# EasyEDA Pro project hardware.eprj, schematic Schematic3
Create Date: 2022-11-23; Page Name: P1; Project Name: SCH_tc264_2022-07-02; Schematic Name: Schematic3; Update Date: 2022-11-23; Company: 嘉立创EDA; Page Size: A2; Version: V1.0
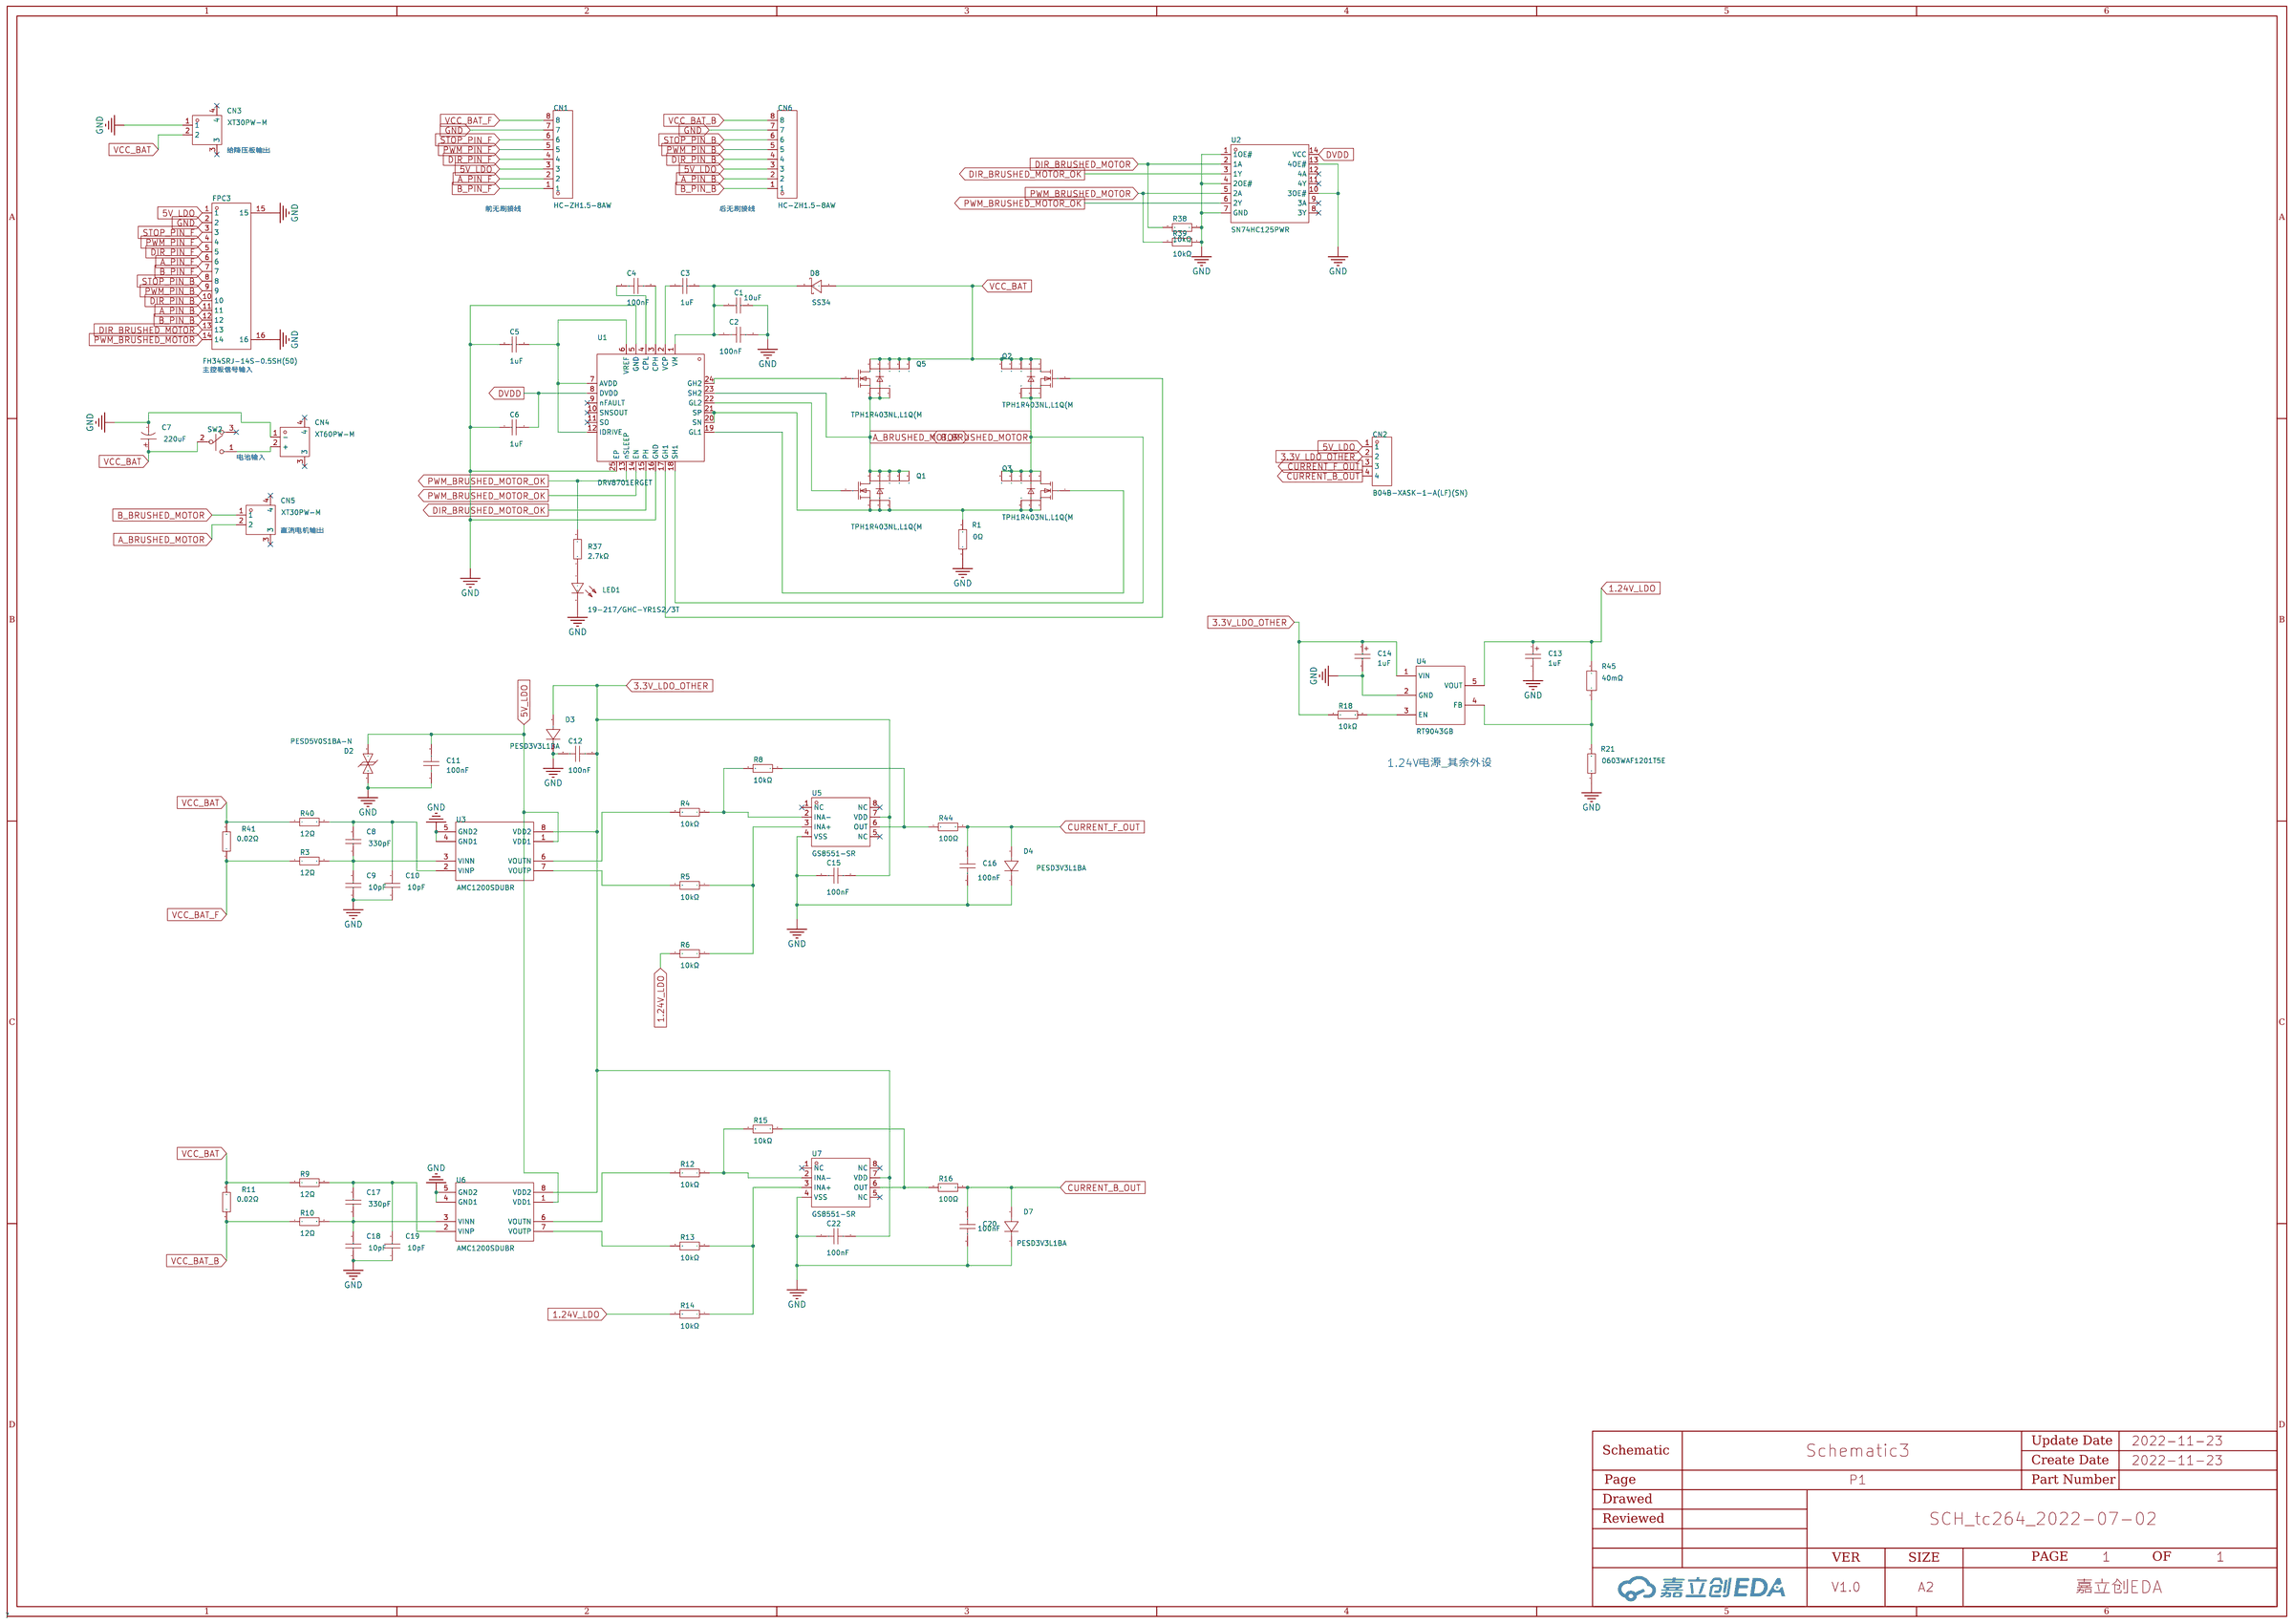
[diagram p3: schematic sheet]

## Parts
C1  10uF  [C1206]
C2  100nF  [C0603]
C3  1uF  [C0603]
C4  100nF  [C0603]
C5  1uF  [C0603]
C6  1uF  [C0603]
C7  220uF  [CAP-TH_BD10.0-P5.00-D1.0-FD]
C8  330pF  [C0603]
C9  10pF  [C0402]
C10  10pF  [C0402]
C11  100nF  [C0603]
C12  100nF  [C0603]
C13  1uF  [CAP-SMD_L3.2-W1.6-RD]
C14  1uF  [CAP-SMD_L3.2-W1.6-RD]
C15  100nF  [C0603]
C16  100nF  [C0603]
C17  330pF  [C0603]
C18  10pF  [C0402]
C19  10pF  [C0402]
C20  100nF  [C0603]
C22  100nF  [C0603]
CN1  HC-ZH1.5-8AW  [CONN-TH_8P-P1.50_HCTL_HC-ZH1.5-8AW]
CN2  B04B-XASK-1-A(LF)(SN)  [CONN-TH_B04B-XASK-1-A-LF-SN]
CN3  XT30PW-M  [CONN-TH_XT30PW-M]
CN4  XT60PW-M  [CONN-TH_XT60PW-M]
CN5  XT30PW-M  [CONN-TH_XT30PW-M]
CN6  HC-ZH1.5-8AW  [CONN-TH_8P-P1.50_HCTL_HC-ZH1.5-8AW]
D2  PESD5V0S1BA-N  [SOD-323_L1.8-W1.3-LS2.5-BI]
D3  PESD3V3L1BA  [SOD-323_L1.7-W1.3-LS2.6-RD-1]
D4  PESD3V3L1BA  [SOD-323_L1.7-W1.3-LS2.6-RD-1]
D7  PESD3V3L1BA  [SOD-323_L1.7-W1.3-LS2.6-RD-1]
D8  SS34  [DO-214AC_L4.3-W2.7-LS5.3-RD]
FPC3  FH34SRJ-14S-0.5SH(50)  [FFC-SMD_14P-P0.50_FH34SRJ-14S-0.5SH]
LED1  19-217/GHC-YR1S2/3T  [LED0603-R-RD]
Q1  TPH1R403NL,L1Q(M  [DSOP-8_L5.0-W5.0-P1.27-LS6.0-BL-EP]
Q2  TPH1R403NL,L1Q(M  [DSOP-8_L5.0-W5.0-P1.27-LS6.0-BL-EP]
Q3  TPH1R403NL,L1Q(M  [DSOP-8_L5.0-W5.0-P1.27-LS6.0-BL-EP]
Q5  TPH1R403NL,L1Q(M  [DSOP-8_L5.0-W5.0-P1.27-LS6.0-BL-EP]
R1  0Ω  [R0603]
R3  12Ω  [R0402]
R4  10kΩ  [R0603]
R5  10kΩ  [R0603]
R6  10kΩ  [R0603]
R8  10kΩ  [R0603]
R9  12Ω  [R0402]
R10  12Ω  [R0402]
R11  0.02Ω  [R2512]
R12  10kΩ  [R0603]
R13  10kΩ  [R0603]
R14  10kΩ  [R0603]
R15  10kΩ  [R0603]
R16  100Ω  [R0603]
R18  10kΩ  [R0603]
R21  0603WAF1201T5E  [R0603]
R37  2.7kΩ  [R0603]
R38  10kΩ  [R0603]
R39  10kΩ  [R0603]
R40  12Ω  [R0402]
R41  0.02Ω  [R2512]
R44  100Ω  [R0603]
R45  40mΩ  [R0603]
SW2  MT-0-103-A101-M200-RS+PJ  [SW-TH_MT-0-103-A101-M200-RS]
U1  DRV8701ERGET  [VQFN-24_L4.0-W4.0-P0.50-LS4.0-BL-EP]
U2  SN74HC125PWR  [TSSOP-14_L5.0-W4.4-P0.65-LS6.5-BL]
U3  AMC1200SDUBR  [SOP-8_L9.8-W6.6-P2.54-LS10.3-BL]
U4  RT9043GB  [SOT-23-5_L3.0-W1.7-P0.95-LS2.8-BR]
U5  GS8551-SR  [SOP-8_L4.9-W3.9-P1.27-LS6.0-BL]
U6  AMC1200SDUBR  [SOP-8_L9.8-W6.6-P2.54-LS10.3-BL]
U7  GS8551-SR  [SOP-8_L4.9-W3.9-P1.27-LS6.0-BL]

## Library data of the parts
C1 = CL31A106KBHNNNE: 容值:10uF;精度:±10%;额定电压:50V;材质(温度系数):X5R;; LCSC Part Name: 10uF ±10% 50V; Supplier Part: C13585; Manufacturer: SAMSUNG(三星); Supplier Footprint: 1206; JLCPCB Part Class: Basic Part; Datasheet: https://atta.szlcsc.com/upload/public/pdf/source/20160103/1457707668742.pdf; Supplier: LCSC; Tolerance: ±10%; Voltage Rated: 50V; Temperature Coefficient: X5R
C2 C4 C11 C12 C15 C16 C20 C22 = CC0603KRX7R9BB104: 容值:100nF;精度:±10%;额定电压:50V;材质(温度系数):X7R;; LCSC Part Name: 100nF ±10% 50V; Supplier Part: C14663; Manufacturer: YAGEO(国巨); Supplier Footprint: 0603; JLCPCB Part Class: Basic Part; Datasheet: https://atta.szlcsc.com/upload/public/pdf/source/20170116/1484561234239.pdf; Supplier: LCSC; Tolerance: ±10%; Voltage Rated: 50V; Temperature Coefficient: X7R
C3 C5 C6 = CL10A105KB8NNNC: 温度系数:X5R;精度:±10%;额定电压:50V;容值:1uF;; LCSC Part Name: 1uF(105) ±10% 50V; Supplier Part: C15849; Manufacturer: SAMSUNG(三星); Supplier Footprint: 0603; JLCPCB Part Class: Basic Part; Datasheet: https://atta.szlcsc.com/upload/public/pdf/source/20160103/1457707679084.pdf; Supplier: LCSC; Temperature Coefficient: X5R; Tolerance: ±10%; Voltage Rated: 50V
C7 = KM227M050G13RR0VH2FP0: 容值:220uF;脚间距:5mm;纹波电流:-;额定电压:50V;等效串联电阻:-;精度:±20%;工作寿命:2000hrs 105;电容体直径:10mm;工作温度:-;电容体长度:13mm;; LCSC Part Name: 220uF 50V; Supplier Part: C45105; Manufacturer: CX(承兴); Supplier Footprint: 径向引线,10x13mm; JLCPCB Part Class: Extended Part; Datasheet: https://atta.szlcsc.com/upload/public/pdf/source/20151029/1457707529682.pdf; Supplier: LCSC; Lead Spacing: 5mm; Rated Voltage: 50V; Tolerance: ±20%; Lifetime @ Temp: 2000hrs 105; φD: 10mm; L: 13mm
C8 C17 = CC0603JRNPO9BN331: 容值:330pF;精度:±5%;额定电压:50V;材质(温度系数):NP0;; LCSC Part Name: 330pF ±5% 50V; Supplier Part: C62784; Manufacturer: YAGEO(国巨); Supplier Footprint: 0603; JLCPCB Part Class: Extended Part; Datasheet: https://atta.szlcsc.com/upload/public/pdf/source/20151222/1457707651299.pdf; Supplier: LCSC; Tolerance: ±5%; Voltage Rated: 50V; Temperature Coefficient: NP0
C9 C10 C18 C19 = CC0402JRNPO9BN100: 容值:10pF;精度:±5%;额定电压:50V;材质(温度系数):NP0;; LCSC Part Name: 10pF ±5% 50V; Supplier Part: C106199; Manufacturer: YAGEO(国巨); Supplier Footprint: 0402; JLCPCB Part Class: Extended Part; Datasheet: https://atta.szlcsc.com/upload/public/pdf/source/20170518/1495085708228.pdf; Supplier: LCSC; Tolerance: ±5%; Voltage Rated: 50V; Temperature Coefficient: NP0
C13 C14 = TAJA105K016RNJ: 容值:1uF;精度:±10%;额定电压:16V;等效串联电阻:-;工作温度:-55~+125;; LCSC Part Name: 1uF ±10% 16V; Supplier Part: C7174; Manufacturer: Kyocera AVX; Supplier Footprint: CASE-A_3216; JLCPCB Part Class: Extended Part; Datasheet: https://atta.szlcsc.com/upload/public/pdf/source/20160107/1457707748219.pdf; Supplier: LCSC; Tolerance: ±10%; Rated Voltage: 16V; Operating Temperature: -55~+125
CN1 CN6 = HC-ZH1.5-8AW: 参考系列:ZH;间距:1.5mm;插针结构:1x8P;排数:1;每排PIN数:8;行距:-;公母:公型插针;安装方式:弯插;额定电流:1A;工作温度范围:-25~+85;; LCSC Part Name: 8P 间距P=1.5mm; Supplier Part: C2845571; Manufacturer: HCTL(华灿天禄); Supplier Footprint: 插件,P=1.5mm; JLCPCB Part Class: Extended Part; Datasheet: https://atta.szlcsc.com/upload/public/pdf/source/20211122/624702E7E83328BF37B6C704FA01E49F.pdf; Supplier: LCSC; Reference Series: ZH; Pitch: 1.5mm; Pins Structure: 1x8P; Number of Rows: 1; Number of PINs Per Row: 8; Gender: 公型插针; Mounting Style: 弯插; Current Rating (Max): 1A; Operating Temperature Range: -25~+85
CN2 = B04B-XASK-1-A(LF)(SN): 参考系列:XA;间距:2.5mm;插针结构:1x4P;排数:1;每排PIN数:4;行距:-;公母:公型插针;安装方式:直插;额定电流:3A;工作温度范围:-25~+85;; LCSC Part Name: 4P 脚距2.5mm; Supplier Part: C491709; Manufacturer: JST; Supplier Footprint: 插件,P=2.5mm; JLCPCB Part Class: Extended Part; Datasheet: https://atta.szlcsc.com/upload/public/pdf/source/20200416/C514162_2DCD7D1CD2019D14145B8FEA1B6236C2.pdf; Supplier: LCSC; Reference Series: XA; Pitch: 2.5mm; Pins Structure: 1x4P; Number of Rows: 1; Number of PINs Per Row: 4; Gender: 公型插针; Mounting Style: 直插; Current Rating (Max): 3A; Operating Temperature Range: -25~+85
CN3 CN5 = XT30PW-M: Socket,DCsupply,XT30,male,PIN:2; LCSC Part Name: XT30PW-M公头; Supplier Part: C431092; Manufacturer: AMASS(艾迈斯); Supplier Footprint: Through Hole; JLCPCB Part Class: Extended Part; Datasheet: https://atta.szlcsc.com/upload/public/pdf/source/20220222/6A9F22F7850E25B33E1BE430ADF8560B.pdf; Supplier: LCSC
CN4 = XT60PW-M: 模型锂电连接器; LCSC Part Name: XT60PW 公头 板插卧式; Supplier Part: C98732; Manufacturer: AMASS(艾迈斯); Supplier Footprint: Through Hole; JLCPCB Part Class: Extended Part; Datasheet: https://atta.szlcsc.com/upload/public/pdf/source/20180125/C98732_15168617837851301983.pdf; Supplier: LCSC
D2 = PESD5V0S1BA-N: 极性:Bidirectional;反向关断电压（典型值）:5V (Max);击穿电压（最小值）:6V;箝位电压:21V;峰值脉冲电流（10/1000us）:17A (8/20us);; Supplier Part: C314260; Manufacturer: BORN伯恩半导体; Supplier Footprint: SOD-323; JLCPCB Part Class: Extended Part; Datasheet: https://atta.szlcsc.com/upload/public/pdf/source/20181015/C314260_74616720B766DD44AADECF2576FF880A.pdf; Supplier: LCSC; Polarity: Bidirectional; Voltage - Reverse Standoff (Typ): 5V (Max); Voltage - Breakdown (Min): 6V; Voltage - Clamping (Max) @ Ipp: 21V; Current - Peak Pulse (10/1000μs): 17A (8/20us)
D3 D4 D7 = PESD3V3L1BA_C2939000: 反向截止电压(Vrwm)：3.3V 击穿电压(最小值)：4V 峰值脉冲电流(Ipp)@tp=8/20s：20A 最大钳位电压：10.5V; Supplier Part: C2939000; Manufacturer: KUU; Supplier Footprint: SOD-323; JLCPCB Part Class: Extended Part; Datasheet: https://atta.szlcsc.com/upload/public/pdf/source/20220104/1AF8E95A9217555EAE6BA1A0A1369AB5.pdf; Supplier: LCSC
D8 = SS34_C8678: 40V,3A,VF=0.55V 3A; Supplier Part: C8678; Manufacturer: MDD; Supplier Footprint: SMA(DO-214AC); JLCPCB Part Class: Basic Part; Datasheet: https://atta.szlcsc.com/upload/public/pdf/source/20220408/D0396E57A6E83C6AFC0ED25EC9EDE030.pdf; Supplier: LCSC
FPC3 = FH34SRJ-14S-0.5SH(50): 间距:0.5mm;触点数量:14;锁定特性:-;安装类型:卧贴;触点类型:双侧触点/上下接;; LCSC Part Name: 0.5mm P数:14 双侧触点/上下接; Supplier Part: C324724; Manufacturer: HRS(广濑); Supplier Footprint: SMD,P=0.5mm; JLCPCB Part Class: Extended Part; Datasheet: https://atta.szlcsc.com/upload/public/pdf/source/20181106/C324724_DC7CE3D3468642B05BE9C7F247386E31.pdf; Supplier: LCSC; Pitch: 0.5mm; Number of Contacts: 14; Mounting Type: 卧贴; Contact Type: 双侧触点/上下接; Height Above Board: 1mm; FFC, FCB Thickness: 0.3mm
LED1 = 19-217/GHC-YR1S2/3T: 照明颜色:翠绿;色温 - CCT（K）:-;主波长/色坐标:520~535nm;; LCSC Part Name: 翠绿LED; Supplier Part: C72043; Manufacturer: EVERLIGHT(台湾亿光); Supplier Footprint: 0603; JLCPCB Part Class: Basic Part; Datasheet: https://atta.szlcsc.com/upload/public/pdf/source/20160507/1462613613780.pdf; Supplier: LCSC; Mounting Type: 表面贴装; Illumination Color: 翠绿; Luminous Intensity (IF=20mA): 112~258mcd; Dominant Wavelength / Coordinate rank: 520~535nm
Q1-Q3 Q5 = TPH1R403NL,L1Q(M: Supplier Part: C2940403; Manufacturer: TOSHIBA(东芝); Supplier Footprint: SOP-8; Datasheet: https://atta.szlcsc.com/upload/public/pdf/source/20220830/C277A7BCA37DB7348B2C95BA2E6DA6BE.pdf; Supplier: LCSC
R1 = 0603WAF0000T5E: 温度系数:-;精度:±1%;阻值:0Ω;功率:1/10W;最大工作电压:75V;工作温度范围:-55~+155;; LCSC Part Name: 0Ω ±1%; Supplier Part: C21189; Manufacturer: UNI-ROYAL(厚声); Supplier Footprint: 0603; JLCPCB Part Class: Basic Part; Datasheet: https://atta.szlcsc.com/upload/public/pdf/source/20170920/C21189_1505887441435980537.pdf; Supplier: LCSC; Tolerance: ±1%; Power(Watts): 1/10W; Overload Voltage (Max): 75V; Operating Temperature Range: -55~+155
R3 R9 R10 R40 = AR02BTC0120: 温度系数:±25ppm/;功率:1/16W;精度:±0.1%;阻值:12Ω;工作温度范围:-55~+155;电阻类型:薄膜电阻;最大工作电压:25V;; LCSC Part Name: 12Ω ±0.1%; Supplier Part: C317902; Manufacturer: Viking(光颉); Supplier Footprint: 0402; JLCPCB Part Class: Extended Part; Datasheet: https://atta.szlcsc.com/upload/public/pdf/source/20181031/C317902_C993E8B47B3BD465DE6386902EF1EEAB.pdf; Supplier: LCSC; Temperature Coefficient: ±25ppm/; Power(Watts): 1/16W; Tolerance: ±0.1%; Operating Temperature Range: -55~+155; Type: 薄膜电阻; Overload Voltage (Max): 25V
R4-R6 R8 R12-R15 R18 R38 R39 = 0603WAF1002T5E: 电阻类型:厚膜电阻;阻值:10kΩ;精度:±1%;功率:100mW;温度系数:±100ppm/;最大工作电压:75V;工作温度范围:-55~+155;; LCSC Part Name: 10kΩ ±1% 100mW; Supplier Part: C25804; Manufacturer: UNI-ROYAL(厚声); Supplier Footprint: 0603; JLCPCB Part Class: Basic Part; Datasheet: https://atta.szlcsc.com/upload/public/pdf/source/20200306/C422600_1E6D84923E4A46A82E41ADD87F860B5C.pdf; Supplier: LCSC; Type: 厚膜电阻; Tolerance: ±1%; Power(Watts): 100mW; Temperature Coefficient: ±100ppm/; Overload Voltage (Max): 75V; Operating Temperature Range: -55~+155
R11 R41 = FMF25FPJR020-LH: 精度:±1%;阻值:0.02Ω;功率:2W;温度系数:±70ppm/;; LCSC Part Name: 0.02Ω(R020) ±1% 2W; Supplier Part: C105360; Manufacturer: PSA(信昌电陶); Supplier Footprint: 2512; JLCPCB Part Class: Extended Part; Datasheet: https://atta.szlcsc.com/upload/public/pdf/source/20170410/1491788443938.pdf; Supplier: LCSC; Tolerance: ±1%; Power(Watts): 2W; Temperature Coefficient: ±70ppm/
R16 R44 = RT0603BRD07100RL: 电阻类型:薄膜电阻;阻值:100Ω;精度:±0.1%;功率:100mW;温度系数:±25ppm/;最大工作电压:75V;工作温度范围:-55~+155;; LCSC Part Name: 100Ω ±0.1% 100mW; Supplier Part: C122970; Manufacturer: YAGEO(国巨); Supplier Footprint: 0603; JLCPCB Part Class: Extended Part; Datasheet: https://atta.szlcsc.com/upload/public/pdf/source/20170728/C122970_1501225762145848821.pdf; Supplier: LCSC; Type: 薄膜电阻; Tolerance: ±0.1%; Power(Watts): 100mW; Temperature Coefficient: ±25ppm/; Overload Voltage (Max): 75V; Operating Temperature Range: -55~+155
R21 = 0603WAF1201T5E: LCSC Part Name: 1.2KΩ(1201) ±1% 编带; Supplier Part: C22765; Manufacturer: UNI-ROYAL(厚声); Supplier Footprint: 0603; JLCPCB Part Class: Basic Part; Datasheet: https://atta.szlcsc.com/upload/public/pdf/source/20170920/C22765_1505887453653980563.pdf; Supplier: LCSC
R37 = 0603WAF2701T5E: 电阻类型:厚膜电阻;阻值:2.7kΩ;精度:±1%;功率:100mW;温度系数:±100ppm/;最大工作电压:75V;工作温度范围:-55~+155;; LCSC Part Name: 2.7kΩ ±1% 100mW; Supplier Part: C13167; Manufacturer: UNI-ROYAL(厚声); Supplier Footprint: 0603; JLCPCB Part Class: Basic Part; Datasheet: https://atta.szlcsc.com/upload/public/pdf/source/20200306/C422600_1E6D84923E4A46A82E41ADD87F860B5C.pdf; Supplier: LCSC; Type: 厚膜电阻; Tolerance: ±1%; Power(Watts): 100mW; Temperature Coefficient: ±100ppm/; Overload Voltage (Max): 75V; Operating Temperature Range: -55~+155
R45 = 0603WAJ040LT5E: 电阻类型:厚膜电阻;阻值:40mΩ;精度:±5%;功率:100mW;温度系数:±800ppm/;最大工作电压:75V;工作温度范围:-55~+155;; LCSC Part Name: 40mΩ ±5% 100mW; Supplier Part: C422883; Manufacturer: UNI-ROYAL(厚声); Supplier Footprint: 0603; JLCPCB Part Class: Extended Part; Datasheet: https://atta.szlcsc.com/upload/public/pdf/source/20200306/C422600_1E6D84923E4A46A82E41ADD87F860B5C.pdf; Supplier: LCSC; Type: 厚膜电阻; Tolerance: ±5%; Power(Watts): 100mW; Temperature Coefficient: ±800ppm/; Overload Voltage (Max): 75V; Operating Temperature Range: -55~+155
SW2 = MT-0-103-A101-M200-RS+PJ: 额定电流:5A;额定电压(AC):125V;电路结构:单刀双掷;钮柄形状:圆柱钮柄;引脚样式:焊片;安装方式:直插;工作温度:-25~+85;开关长度:13mm;开关宽度:8mm;开关高度:28.6mm;; LCSC Part Name: 小型钮子三脚三档(五件套); Supplier Part: C1788493; Manufacturer: YUEN FUNG(源丰); Supplier Footprint: 插件; JLCPCB Part Class: Extended Part; Datasheet: https://atta.szlcsc.com/upload/public/pdf/source/20201225/C1788493_608759AD4D4A20FF90A03E3E3321FD91.pdf; Supplier: LCSC; Contact Current: 5A; Voltage Rating (AC): 125V; Circuit: 单刀双掷; Actuator Type: 圆柱钮柄; Pin Style: 焊片; Mounting Style: 直插; Operating Temperature: -25~+85; Switch Length: 13mm; Switch Width: 8mm; Switch Height: 28.6mm
U1 = DRV8701ERGET: DRV8701 DRV8701 H 桥栅极驱动器; Supplier Part: C132049; Manufacturer: TI(德州仪器); Supplier Footprint: VQFN-24; JLCPCB Part Class: Extended Part; Datasheet: https://atta.szlcsc.com/upload/public/pdf/source/20170925/C132049_1506321643935990409.pdf; Supplier: LCSC
U2 = SN74HC125PWR: 逻辑电路的归属系列:74HC;逻辑类型:缓冲器，非反向;元件数:4;每元件位数:1;; Supplier Part: C132994; Manufacturer: TI(德州仪器); Supplier Footprint: TSSOP-14; JLCPCB Part Class: Extended Part; Datasheet: https://atta.szlcsc.com/upload/public/pdf/source/20170930/C132994_1506736365150997346.pdf; Supplier: LCSC; Series: 74HC; Logic Type: 缓冲器，非反向; Number of Elements: 4; Number of Bits per Element: 1; Output Type: 三态; Current - Output High, Low: 7.8mA、7.8mA; Voltage - Supply: 2V ~ 6V; Operating Temperature: -40~+85（TA）
U3 U6 = AMC1200SDUBR: AMC1200 用于并联测量的 4kV 峰值隔离放大器; Supplier Part: C39673; Manufacturer: TI(德州仪器); Supplier Footprint: SOP-8_6.6mm; JLCPCB Part Class: Extended Part; Datasheet: https://atta.szlcsc.com/upload/public/pdf/source/20141219/1457707254732.pdf; Supplier: LCSC
U4 = RT9043GB: 输出类型:可调;输出极性:正;输出通道数:1;最大输入电压:5.5V;输出电压:1.2V~5V;压差:350mV@(400mA);输出电流:400mA;电源纹波抑制比(PRSS):67dB@(1kHz),56dB@(10kHz);; LCSC Part Name: Vin=5.5V Vout=1.2V~5V 400mA 67dB@(1kHz),56dB@(10kHz); Supplier Part: C55019; Manufacturer: RICHTEK(台湾立锜); Supplier Footprint: SOT-23-5; JLCPCB Part Class: Extended Part; Datasheet: https://atta.szlcsc.com/upload/public/pdf/source/20150811/1457707342352.pdf; Supplier: LCSC; Output Type: 可调; Output Polarity: 正; Number of Outputs: 1; Maximum Input Voltage: 5.5V; Output Voltage: 1.2V~5V; Dropout Voltage: 350mV@(400mA); Output Current: 400mA; Power Supply Rejection Ratio (PRSS): 67dB@(1kHz),56dB@(10kHz)
U5 U7 = GS8551-SR: Supplier Part: C2927684; Manufacturer: Gainsil(聚洵); Supplier Footprint: SOP-8; JLCPCB Part Class: Extended Part; Datasheet: https://atta.szlcsc.com/upload/public/pdf/source/20200615/C605420_EE0E567F8FF01D919583B114644E1CC3.pdf; Supplier: LCSC

## Nets
1.24V_LDO: C13.1 R6.2 R14.2 R45.2 U4.5(VOUT)
3.3V_LDO_OTHER: C12.1 C14.1 C15.1 C22.1 CN2.2 D3.2(A) R18.1 U3.8(VDD2) U4.1(VIN) U5.7(VDD) U6.8(VDD2) U7.7(VDD)
5V_LDO: C11.2 CN1.3 CN2.1 CN6.3 D2.1 FPC3.1 U3.1(VDD1) U6.1(VDD1)
DVDD: C6.2 U1.8(DVDD) U2.14(VCC)
GND: C1.1 C2.2 C5.1 C6.1 C7.2 C9.1 C10.1 C11.1 C12.2 C13.2 C14.2 C15.2 C16.2 C18.1 C19.1 C20.1 C22.2 CN1.7 CN3.1 CN4.1(-) CN6.7 D2.2 D3.1(K) D4.1(K) D7.1(K) FPC3.2 FPC3.15 FPC3.16 LED1.2(C) R1.1 R21.1 R38.1 R39.1 U1.5(GND) U1.16(GND) U1.25(EP) U2.1(1OE#) U2.4(2OE#) U2.7(GND) U2.10(3OE#) U2.13(4OE#) U3.4(GND1) U3.5(GND2) U4.2(GND) U5.4(VSS) U6.4(GND1) U6.5(GND2) U7.4(VSS)
VCC_BAT: C7.1 CN3.2 D8.2(A) Q2.5(D) Q2.6(D) Q2.7(D) Q2.8(D) Q2.9(D) Q5.5(D) Q5.6(D) Q5.7(D) Q5.8(D) Q5.9(D) R9.1 R11.2 R40.1 R41.2 SW2.2
VCC_BAT_B: CN6.8 R10.1 R11.1
VCC_BAT_F: CN1.8 R3.1 R41.1
A_BRUSHED_MOTOR: CN5.2 Q1.5(D) Q1.6(D) Q1.7(D) Q1.8(D) Q1.9(D) Q5.1(S) Q5.2(S) Q5.3(S) U1.23(SH2)
A_PIN_B: CN6.2 FPC3.11
A_PIN_F: CN1.2 FPC3.6
B_BRUSHED_MOTOR: CN5.1 Q2.1(S) Q2.2(S) Q2.3(S) Q3.5(D) Q3.6(D) Q3.7(D) Q3.8(D) Q3.9(D) U1.18(SH1)
B_PIN_B: CN6.1 FPC3.12
B_PIN_F: CN1.1 FPC3.7
CURRENT_B_OUT: C20.2 CN2.4 D7.2(A) R16.2
CURRENT_F_OUT: C16.1 CN2.3 D4.2(A) R44.2
DIR_BRUSHED_MOTOR: FPC3.13 R38.2 U2.2(1A)
DIR_BRUSHED_MOTOR_OK: U1.15(PH) U2.3(1Y)
DIR_PIN_B: CN6.4 FPC3.10
DIR_PIN_F: CN1.4 FPC3.5
PWM_BRUSHED_MOTOR: FPC3.14 R39.2 U2.5(2A)
PWM_BRUSHED_MOTOR_OK: R37.2 U1.13(nSLEEP) U1.14(EN) U2.6(2Y)
PWM_PIN_B: CN6.5 FPC3.9
PWM_PIN_F: CN1.5 FPC3.4
STOP_PIN_B: CN6.6 FPC3.8
STOP_PIN_F: CN1.6 FPC3.3
$1N6283: C3.1 U1.2(VCP)
$1N6286: C1.2 C2.1 C3.2 D8.1(K) U1.1(VM)
$1N6407: C4.2 U1.3(CPH)
$1N6423: C4.1 U1.4(CPL)
$1N6482: C5.2 U1.6(VREF) U1.7(AVDD) U1.12(IDRIVE)
$1N8790: Q5.4(G) U1.24(GH2)
$1N8877: Q1.4(G) U1.22(GL2)
$1N10833: Q1.1(S) Q1.2(S) Q1.3(S) Q3.1(S) Q3.2(S) Q3.3(S) R1.2 U1.20(SN) U1.21(SP)
$1N11378: Q3.4(G) U1.19(GL1)
$1N11551: Q2.4(G) U1.17(GH1)
$1N15429: LED1.1(A) R37.1
$1N27332: C8.2 C10.2 R40.2 U3.2(VINP)
$1N27558: C8.1 C9.2 R3.2 U3.3(VINN)
$1N29270: R4.2 U3.6(VOUTN)
$1N29391: R5.2 U3.7(VOUTP)
$1N35153: R5.1 R6.1 U5.3(INA+)
$1N37079: R21.2 R45.1 U4.4(FB)
$1N37080: R18.2 U4.3(EN)
$1N38660: R4.1 R8.2 U5.2(INA-)
$1N38667: R8.1 R44.1 U5.6(OUT)
$1N44285: C17.1 C18.2 R10.2 U6.3(VINN)
$1N44287: C17.2 C19.2 R9.2 U6.2(VINP)
$1N44289: R12.2 U6.6(VOUTN)
$1N44290: R13.2 U6.7(VOUTP)
$1N44294: R13.1 R14.1 U7.3(INA+)
$1N44296: R12.1 R15.2 U7.2(INA-)
$1N44299: R15.1 R16.1 U7.6(OUT)
$1N88952: CN4.2(+) SW2.1

Not connected (* = marked no-connect by the designer): CN3 3* 4*; CN4 3* 4*; CN5 3* 4*; SW2 3*; U1 9(nFAULT)* 10(SNSOUT)* 11(SO)*; U2 8(3Y)* 9(3A)* 11(4Y)* 12(4A)*; U5 1(NC)* 5(NC)* 8(NC)*; U7 1(NC)* 5(NC)* 8(NC)*

## Notes on the sheet
- 给降压板输出
- 前无刷接线
- 后无刷接线
- 主控板信号输入
- 电池输入
- 直流电机输出
- 1.24V电源_其余外设
